# EasyEDA Pro project Chessboards.epro, schematic Schematic3
Board Name: Quarter; Create Date: 2025-07-22; Page Name: P1; Project Name: coils_sample6; Schematic Name: Schematic3; Update Date: 2025-07-22; Company: EasyEDA.com; Page Size: A4; Version: V1.0
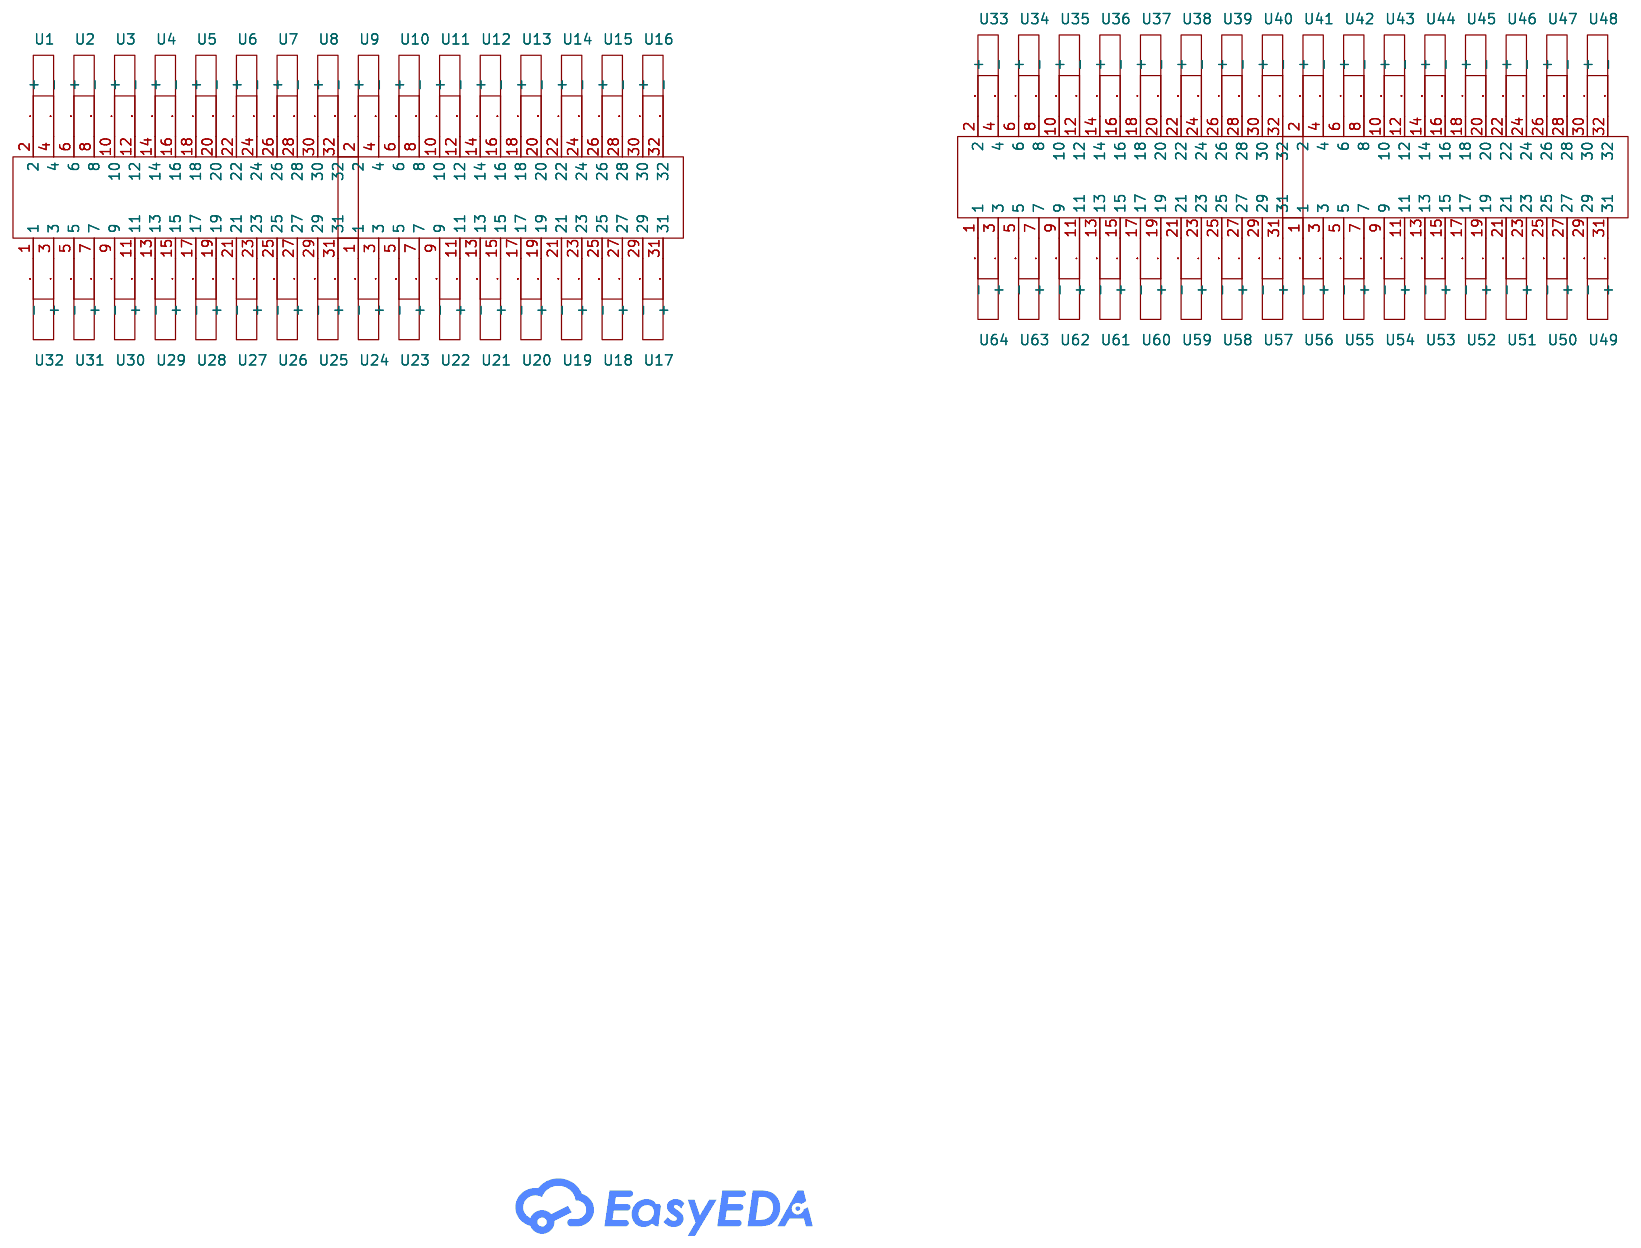
[diagram p0: schematic sheet]

## Parts
H2  BX-PZ1.0-2-16PZZ  [HDR-TH_32P-P1.00-V-M-R2-C16-S1.00]
H3  BX-PZ1.0-2-16PZZ  [HDR-TH_32P-P1.00-V-M-R2-C16-S1.00]
H4  BX-PZ1.0-2-16PZZ  [HDR-TH_32P-P1.00-V-M-R2-C16-S1.00]
H5  BX-PZ1.0-2-16PZZ  [HDR-TH_32P-P1.00-V-M-R2-C16-S1.00]
U1  -  [coil]
U2  -  [coil]
U3  -  [coil]
U4  -  [coil]
U5  -  [coil]
U6  -  [coil]
U7  -  [coil]
U8  -  [coil]
U9  -  [coil]
U10  -  [coil]
U11  -  [coil]
U12  -  [coil]
U13  -  [coil]
U14  -  [coil]
U15  -  [coil]
U16  -  [coil]
U17  -  [coil]
U18  -  [coil]
U19  -  [coil]
U20  -  [coil]
U21  -  [coil]
U22  -  [coil]
U23  -  [coil]
U24  -  [coil]
U25  -  [coil]
U26  -  [coil]
U27  -  [coil]
U28  -  [coil]
U29  -  [coil]
U30  -  [coil]
U31  -  [coil]
U32  -  [coil]
U33  -  [coil]
U34  -  [coil]
U35  -  [coil]
U36  -  [coil]
U37  -  [coil]
U38  -  [coil]
U39  -  [coil]
U40  -  [coil]
U41  -  [coil]
U42  -  [coil]
U43  -  [coil]
U44  -  [coil]
U45  -  [coil]
U46  -  [coil]
U47  -  [coil]
U48  -  [coil]
U49  -  [coil]
U50  -  [coil]
U51  -  [coil]
U52  -  [coil]
U53  -  [coil]
U54  -  [coil]
U55  -  [coil]
U56  -  [coil]
U57  -  [coil]
U58  -  [coil]
U59  -  [coil]
U60  -  [coil]
U61  -  [coil]
U62  -  [coil]
U63  -  [coil]
U64  -  [coil]

## Library data of the parts
H2-H5 = BX-PZ1.0-2-16PZZ: Pin Structure:2x16P Pitch:1mm Row Spacing:1mm Circluar Pins/Square Pins:Pin Header Mounting Type:Through Hole Number of Rows:2 Number of Pins:32P Current Rating:750mA Voltage Rating (Max):- Length of Mating Pin:2mm Insulation Height:1mm Length of End Conn; LCSC Part Name: 2x16P 间距:1mm 方针 直插; Supplier Part: C41370880; Manufacturer: Bossie(博锡); Supplier Footprint: 插件,P=1mm; JLCPCB Part Class: Extended Part; Datasheet: https://atta.szlcsc.com/upload/public/pdf/source/20240828/E1B4429254978AD8CFC84DEEE8589C18.pdf; Supplier: LCSC; Pin Structure: 2x16P; Pitch: 1mm; Row Spacing: 1mm; Circluar Pins/Square Pins: Pin Header; Mounting Type: Through Hole; Number of Rows: 2; Number of Pins: 32P; Current Rating: 750mA; Length of Mating Pin: 2mm; Insulation Height: 1mm; Length of End Connection Pin: 2mm; Contact Material: Brass; Contact Plating: Gold; Operating Temperature: -40℃~+105℃; Color: Black
U1-U64 = coil2

## Nets
$1N10438: H2.2 U1.1(+)
$1N10440: H2.4 U1.2(-)
$1N10442: H2.6 U2.1(+)
$1N10444: H2.8 U2.2(-)
$1N10446: H2.10 U3.1(+)
$1N10448: H2.12 U3.2(-)
$1N10450: H2.14 U4.1(+)
$1N10452: H2.16 U4.2(-)
$1N10454: H2.18 U5.1(+)
$1N10456: H2.20 U5.2(-)
$1N10458: H2.22 U6.1(+)
$1N10460: H2.24 U6.2(-)
$1N10462: H2.26 U7.1(+)
$1N10464: H2.28 U7.2(-)
$1N10466: H2.30 U8.1(+)
$1N10468: H2.32 U8.2(-)
$1N10470: H2.31 U25.1(+)
$1N10472: H2.29 U25.2(-)
$1N10474: H2.27 U26.1(+)
$1N10476: H2.25 U26.2(-)
$1N10478: H2.23 U27.1(+)
$1N10480: H2.21 U27.2(-)
$1N10482: H2.19 U28.1(+)
$1N10484: H2.17 U28.2(-)
$1N10486: H2.15 U29.1(+)
$1N10488: H2.13 U29.2(-)
$1N10490: H2.11 U30.1(+)
$1N10492: H2.9 U30.2(-)
$1N10494: H2.7 U31.1(+)
$1N10496: H2.5 U31.2(-)
$1N10498: H2.3 U32.1(+)
$1N10500: H2.1 U32.2(-)
$1N10638: H3.2 U9.1(+)
$1N10640: H3.4 U9.2(-)
$1N10642: H3.6 U10.1(+)
$1N10644: H3.8 U10.2(-)
$1N10646: H3.10 U11.1(+)
$1N10648: H3.12 U11.2(-)
$1N10650: H3.14 U12.1(+)
$1N10652: H3.16 U12.2(-)
$1N10654: H3.18 U13.1(+)
$1N10656: H3.20 U13.2(-)
$1N10658: H3.22 U14.1(+)
$1N10660: H3.24 U14.2(-)
$1N10662: H3.26 U15.1(+)
$1N10664: H3.28 U15.2(-)
$1N10666: H3.30 U16.1(+)
$1N10668: H3.32 U16.2(-)
$1N10670: H3.31 U17.1(+)
$1N10672: H3.29 U17.2(-)
$1N10674: H3.27 U18.1(+)
$1N10676: H3.25 U18.2(-)
$1N10678: H3.23 U19.1(+)
$1N10680: H3.21 U19.2(-)
$1N10682: H3.19 U20.1(+)
$1N10684: H3.17 U20.2(-)
$1N10686: H3.15 U21.1(+)
$1N10688: H3.13 U21.2(-)
$1N10690: H3.11 U22.1(+)
$1N10692: H3.9 U22.2(-)
$1N10694: H3.7 U23.1(+)
$1N10696: H3.5 U23.2(-)
$1N10698: H3.3 U24.1(+)
$1N10700: H3.1 U24.2(-)
$1N10974: H4.2 U33.1(+)
$1N10976: H4.4 U33.2(-)
$1N10978: H4.6 U34.1(+)
$1N10980: H4.8 U34.2(-)
$1N10982: H4.18 U37.1(+)
$1N10984: H4.20 U37.2(-)
$1N10986: H5.6 U42.1(+)
$1N10988: H5.8 U42.2(-)
$1N10990: H5.10 U43.1(+)
$1N10992: H5.12 U43.2(-)
$1N10994: H5.22 U46.1(+)
$1N10996: H5.24 U46.2(-)
$1N10998: H5.14 U44.1(+)
$1N11000: H5.16 U44.2(-)
$1N11002: H5.18 U45.1(+)
$1N11004: H5.20 U45.2(-)
$1N11006: H4.30 U40.1(+)
$1N11008: H4.32 U40.2(-)
$1N11010: H5.2 U41.1(+)
$1N11012: H5.4 U41.2(-)
$1N11014: H4.10 U35.1(+)
$1N11016: H4.12 U35.2(-)
$1N11018: H4.14 U36.1(+)
$1N11020: H4.16 U36.2(-)
$1N11022: H5.26 U47.1(+)
$1N11024: H5.28 U47.2(-)
$1N11026: H5.30 U48.1(+)
$1N11028: H5.32 U48.2(-)
$1N11030: H4.22 U38.1(+)
$1N11032: H4.24 U38.2(-)
$1N11034: H4.26 U39.1(+)
$1N11036: H4.28 U39.2(-)
$1N11038: H4.3 U64.1(+)
$1N11040: H4.1 U64.2(-)
$1N11042: H4.7 U63.1(+)
$1N11044: H4.5 U63.2(-)
$1N11046: H4.11 U62.1(+)
$1N11048: H4.9 U62.2(-)
$1N11050: H5.3 U56.1(+)
$1N11052: H5.1 U56.2(-)
$1N11054: H4.31 U57.1(+)
$1N11056: H4.29 U57.2(-)
$1N11058: H4.15 U61.1(+)
$1N11060: H4.13 U61.2(-)
$1N11062: H4.19 U60.1(+)
$1N11064: H4.17 U60.2(-)
$1N11066: H4.23 U59.1(+)
$1N11068: H4.21 U59.2(-)
$1N11070: H4.27 U58.1(+)
$1N11072: H4.25 U58.2(-)
$1N11074: H5.15 U53.1(+)
$1N11076: H5.13 U53.2(-)
$1N11078: H5.11 U54.1(+)
$1N11080: H5.9 U54.2(-)
$1N11082: H5.7 U55.1(+)
$1N11084: H5.5 U55.2(-)
$1N11086: H5.31 U49.1(+)
$1N11088: H5.29 U49.2(-)
$1N11090: H5.19 U52.1(+)
$1N11092: H5.17 U52.2(-)
$1N11094: H5.27 U50.1(+)
$1N11096: H5.25 U50.2(-)
$1N11098: H5.23 U51.1(+)
$1N11100: H5.21 U51.2(-)
